# EasyEDA Pro project Zero_PCB_JLCEDA.eprj, schematic Zero_PCB (continued)
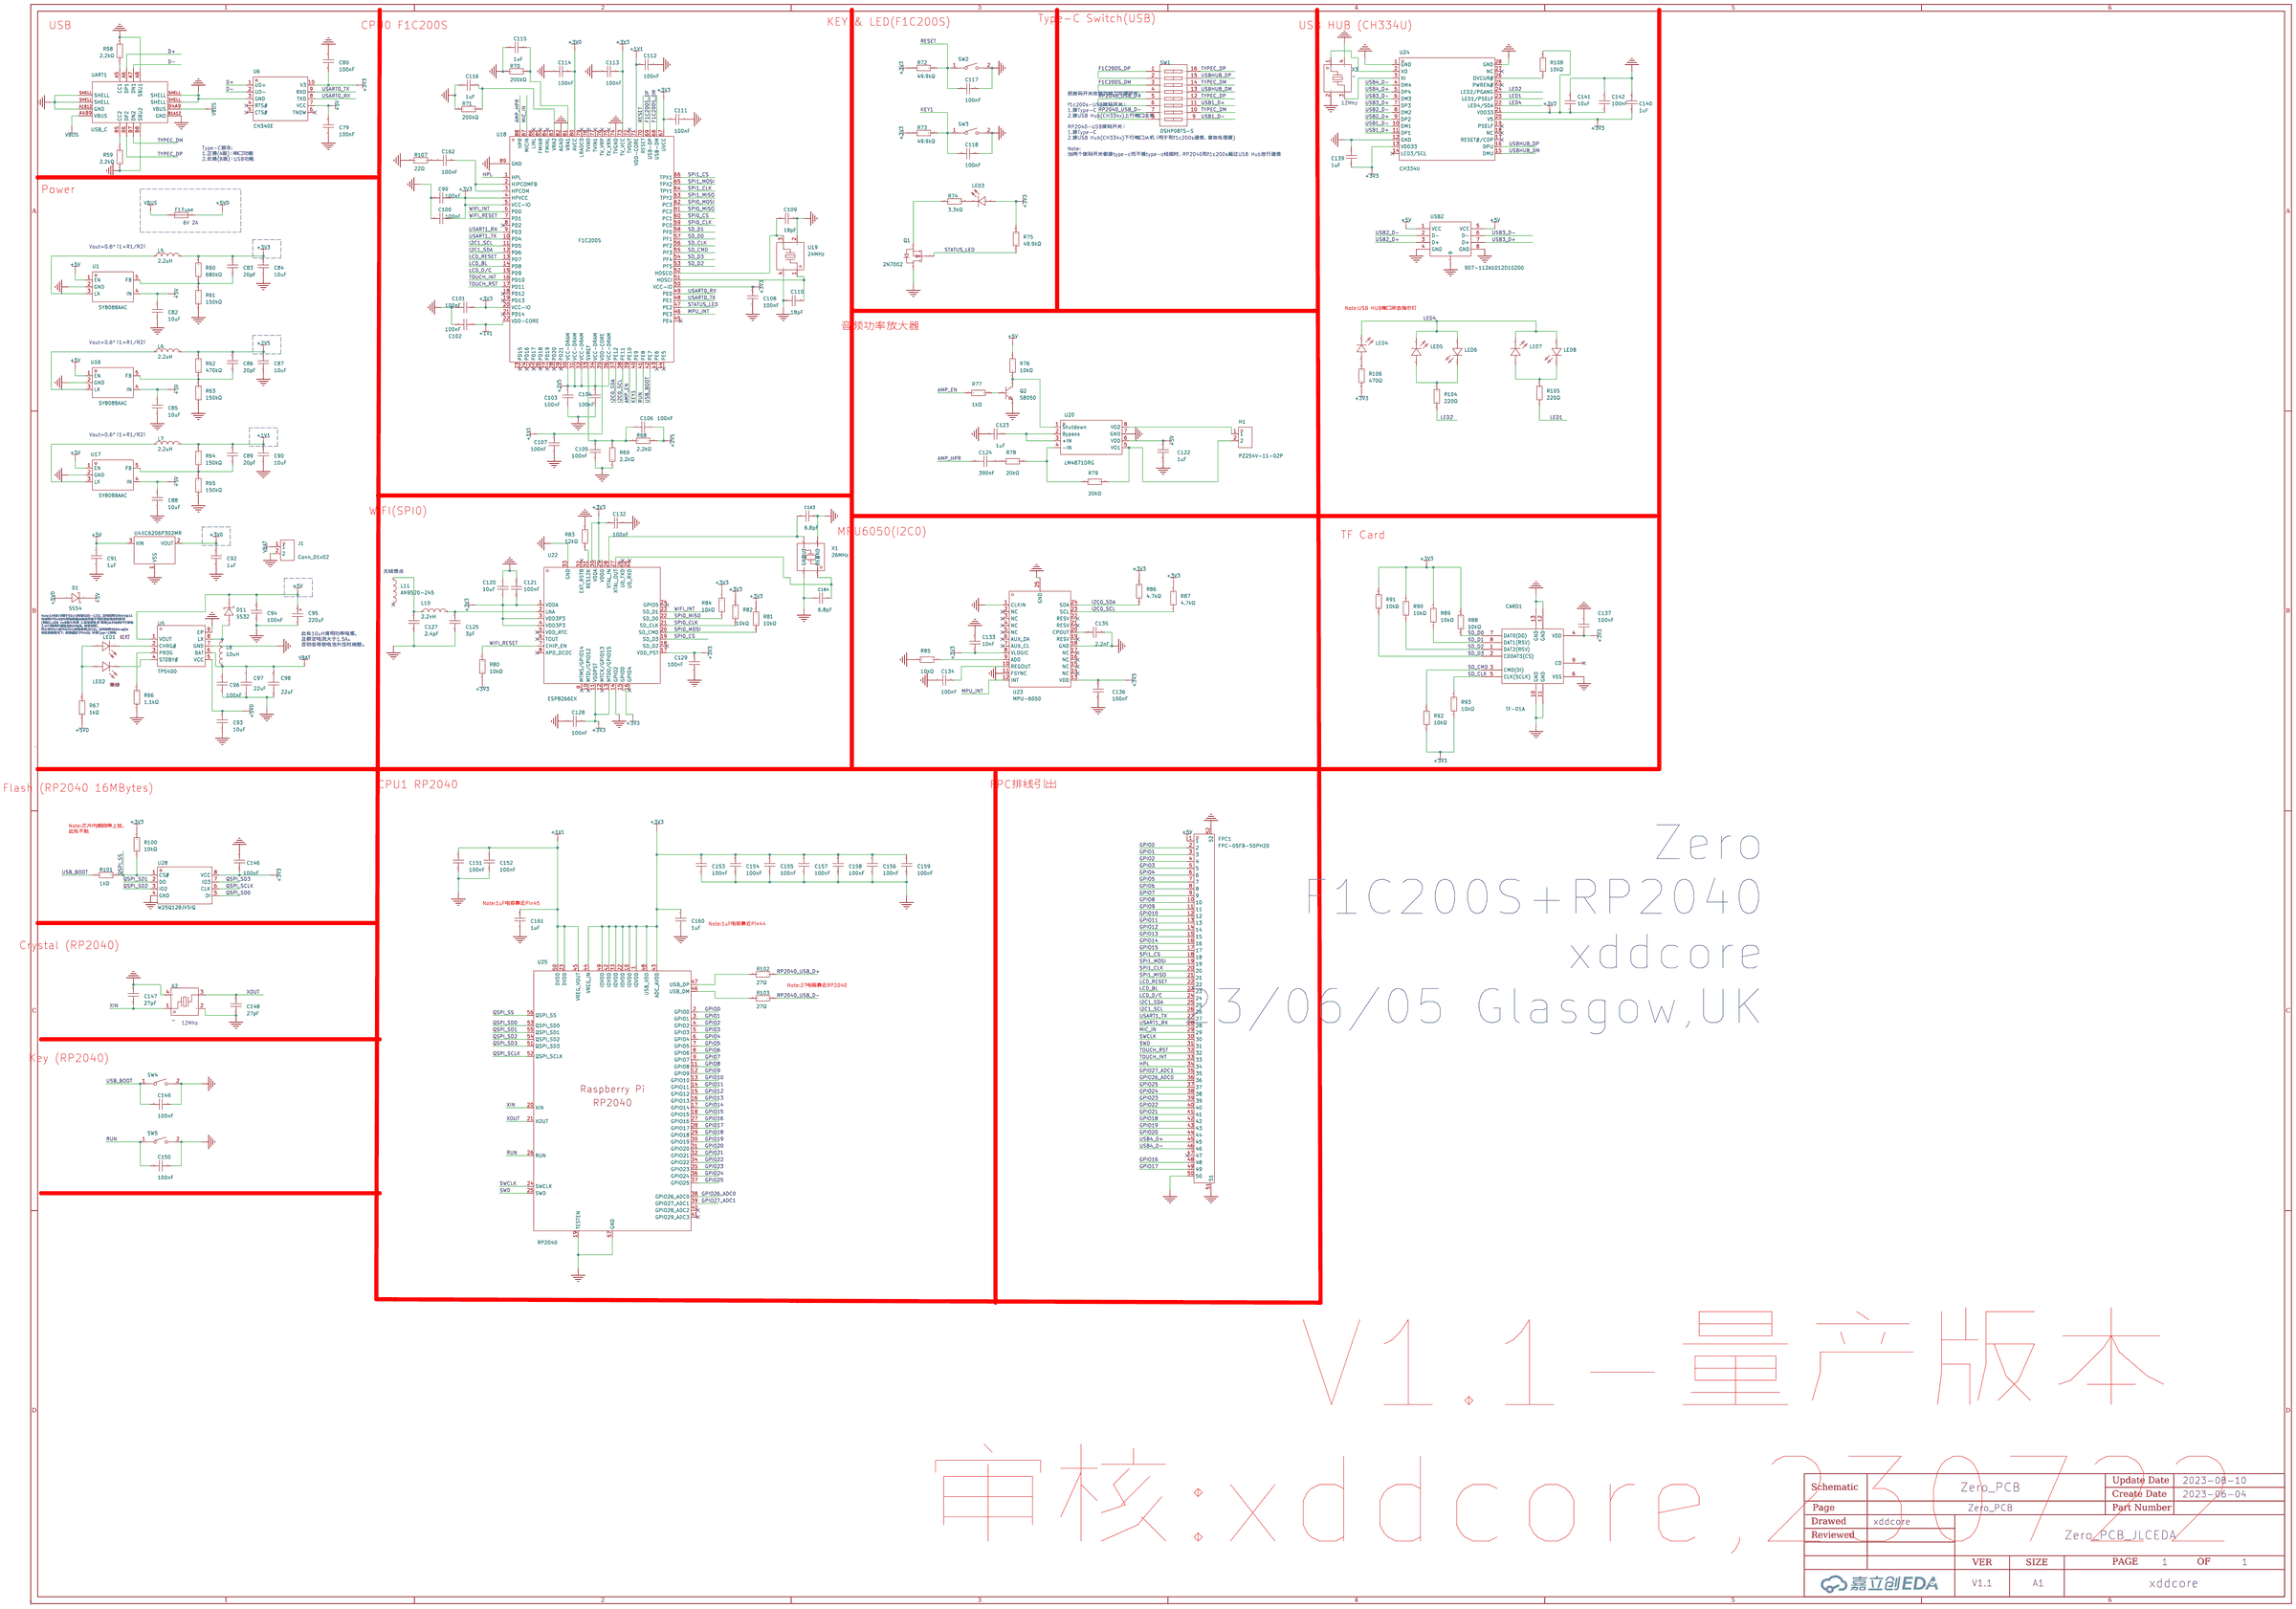
[diagram p0: schematic sheet]
## Library data of the parts (continued)
R60 = RC0402FR-07680KL: 电阻类型:厚膜电阻;阻值:680kΩ;精度:±1%;功率:62.5mW;; LCSC Part Name: 680kΩ ±1% 62.5mW; Supplier Part: C163456; Manufacturer: YAGEO(国巨); Supplier Footprint: 0402; JLCPCB Part Class: Extended Part; Datasheet: https://atta.szlcsc.com/upload/public/pdf/source/20180111/C163456_15156544485521258977.pdf; Supplier: LCSC; Type: 厚膜电阻; Tolerance: ±1%; Power(Watts): 62.5mW; Temperature Coefficient: ±100ppm/℃; Overload Voltage (Max): 50V; Operating Temperature Range: -55℃~+155℃
R61 R63-R65 = 0402WGF1503TCE: 电阻类型:厚膜电阻;阻值:150kΩ;精度:±1%;功率:62.5mW;; LCSC Part Name: 150kΩ ±1% 62.5mW; Supplier Part: C25755; Manufacturer: UNI-ROYAL(厚声); Supplier Footprint: 0402; JLCPCB Part Class: Basic Part; Datasheet: https://atta.szlcsc.com/upload/public/pdf/source/20200306/C422600_1E6D84923E4A46A82E41ADD87F860B5C.pdf; Supplier: LCSC; Type: 厚膜电阻; Tolerance: ±1%; Power(Watts): 62.5mW; Temperature Coefficient: ±100ppm/℃; Overload Voltage (Max): 50V; Operating Temperature Range: -55℃~+155℃
R62 = 0402WGF4703TCE: 电阻类型:厚膜电阻;阻值:470kΩ;精度:±1%;功率:62.5mW;; LCSC Part Name: 470kΩ ±1% 62.5mW; Supplier Part: C25790; Manufacturer: UNI-ROYAL(厚声); Supplier Footprint: 0402; JLCPCB Part Class: Basic Part; Datasheet: https://atta.szlcsc.com/upload/public/pdf/source/20200306/C422600_1E6D84923E4A46A82E41ADD87F860B5C.pdf; Supplier: LCSC; Type: 厚膜电阻; Tolerance: ±1%; Power(Watts): 62.5mW; Temperature Coefficient: ±100ppm/℃; Overload Voltage (Max): 50V; Operating Temperature Range: -55℃~+155℃
R66 = 0402WGF1101TCE: 电阻类型:厚膜电阻;阻值:1.1kΩ;精度:±1%;功率:62.5mW;; LCSC Part Name: 1.1kΩ ±1% 62.5mW; Supplier Part: C25860; Manufacturer: UNI-ROYAL(厚声); Supplier Footprint: 0402; JLCPCB Part Class: Extended Part; Datasheet: https://atta.szlcsc.com/upload/public/pdf/source/20200306/C422600_1E6D84923E4A46A82E41ADD87F860B5C.pdf; Supplier: LCSC; Type: 厚膜电阻; Tolerance: ±1%; Power(Watts): 62.5mW; Temperature Coefficient: ±100ppm/℃; Overload Voltage (Max): 50V; Operating Temperature Range: -55℃~+155℃
R67 R77 R101 = 0402WGJ0102TCE: 电阻类型:厚膜电阻;阻值:1kΩ;精度:±5%;功率:62.5mW;; LCSC Part Name: 1kΩ ±5% 62.5mW; Supplier Part: C25543; Manufacturer: UNI-ROYAL(厚声); Supplier Footprint: 0402; JLCPCB Part Class: Extended Part; Datasheet: https://atta.szlcsc.com/upload/public/pdf/source/20200306/C422600_1E6D84923E4A46A82E41ADD87F860B5C.pdf; Supplier: LCSC; Type: 厚膜电阻; Tolerance: ±5%; Power(Watts): 62.5mW; Temperature Coefficient: ±100ppm/℃; Overload Voltage (Max): 50V; Operating Temperature Range: -55℃~+155℃
R70 R71 = 0402WGF2003TCE: 电阻类型:厚膜电阻;阻值:200kΩ;精度:±1%;功率:62.5mW;; LCSC Part Name: 200kΩ ±1% 62.5mW; Supplier Part: C25764; Manufacturer: UNI-ROYAL(厚声); Supplier Footprint: 0402; JLCPCB Part Class: Basic Part; Datasheet: https://atta.szlcsc.com/upload/public/pdf/source/20200306/C422600_1E6D84923E4A46A82E41ADD87F860B5C.pdf; Supplier: LCSC; Type: 厚膜电阻; Tolerance: ±1%; Power(Watts): 62.5mW; Temperature Coefficient: ±100ppm/℃; Overload Voltage (Max): 50V; Operating Temperature Range: -55℃~+155℃
R72 R73 R75 = 0402WGF4992TCE: 电阻类型:厚膜电阻;阻值:49.9kΩ;精度:±1%;功率:62.5mW;; LCSC Part Name: 49.9kΩ ±1% 62.5mW; Supplier Part: C25897; Manufacturer: UNI-ROYAL(厚声); Supplier Footprint: 0402; JLCPCB Part Class: Basic Part; Datasheet: https://atta.szlcsc.com/upload/public/pdf/source/20200306/C422600_1E6D84923E4A46A82E41ADD87F860B5C.pdf; Supplier: LCSC; Type: 厚膜电阻; Tolerance: ±1%; Power(Watts): 62.5mW; Temperature Coefficient: ±100ppm/℃; Overload Voltage (Max): 50V; Operating Temperature Range: -55℃~+155℃
R74 = 0402WGF3301TCE: 电阻类型:厚膜电阻;阻值:3.3kΩ;精度:±1%;功率:62.5mW;; LCSC Part Name: 3.3kΩ ±1% 62.5mW; Supplier Part: C25890; Manufacturer: UNI-ROYAL(厚声); Supplier Footprint: 0402; JLCPCB Part Class: Basic Part; Datasheet: https://atta.szlcsc.com/upload/public/pdf/source/20200306/C422600_1E6D84923E4A46A82E41ADD87F860B5C.pdf; Supplier: LCSC; Type: 厚膜电阻; Tolerance: ±1%; Power(Watts): 62.5mW; Temperature Coefficient: ±100ppm/℃; Overload Voltage (Max): 50V; Operating Temperature Range: -55℃~+155℃
R76 R80-R82 R84 R85 R88-R93 R100 R108 = 0402WGF1002TCE: 电阻类型:厚膜电阻;阻值:10kΩ;精度:±1%;功率:62.5mW;; LCSC Part Name: 10kΩ ±1% 62.5mW; Supplier Part: C25744; Manufacturer: UNI-ROYAL(厚声); Supplier Footprint: 0402; JLCPCB Part Class: Basic Part; Datasheet: https://atta.szlcsc.com/upload/public/pdf/source/20200306/C422600_1E6D84923E4A46A82E41ADD87F860B5C.pdf; Supplier: LCSC; Type: 厚膜电阻; Tolerance: ±1%; Power(Watts): 62.5mW; Temperature Coefficient: ±100ppm/℃; Overload Voltage (Max): 50V; Operating Temperature Range: -55℃~+155℃
R78 R79 = 0402WGF2002TCE: 电阻类型:厚膜电阻;阻值:20kΩ;精度:±1%;功率:62.5mW;; LCSC Part Name: 20kΩ ±1% 62.5mW; Supplier Part: C25765; Manufacturer: UNI-ROYAL(厚声); Supplier Footprint: 0402; JLCPCB Part Class: Basic Part; Datasheet: https://atta.szlcsc.com/upload/public/pdf/source/20200306/C422600_1E6D84923E4A46A82E41ADD87F860B5C.pdf; Supplier: LCSC; Type: 厚膜电阻; Tolerance: ±1%; Power(Watts): 62.5mW; Temperature Coefficient: ±100ppm/℃; Overload Voltage (Max): 50V; Operating Temperature Range: -55℃~+155℃
R83 = 0402WGF1202TCE: 电阻类型:厚膜电阻;阻值:12kΩ;精度:±1%;功率:62.5mW;; LCSC Part Name: 12kΩ ±1% 62.5mW; Supplier Part: C25752; Manufacturer: UNI-ROYAL(厚声); Supplier Footprint: 0402; JLCPCB Part Class: Basic Part; Datasheet: https://atta.szlcsc.com/upload/public/pdf/source/20200306/C422600_1E6D84923E4A46A82E41ADD87F860B5C.pdf; Supplier: LCSC; Type: 厚膜电阻; Tolerance: ±1%; Power(Watts): 62.5mW; Temperature Coefficient: ±100ppm/℃; Overload Voltage (Max): 50V; Operating Temperature Range: -55℃~+155℃
R86 R87 = 0402WGF4701TCE: 电阻类型:厚膜电阻;阻值:4.7kΩ;精度:±1%;功率:62.5mW;; LCSC Part Name: 4.7kΩ ±1% 62.5mW; Supplier Part: C25900; Manufacturer: UNI-ROYAL(厚声); Supplier Footprint: 0402; JLCPCB Part Class: Basic Part; Datasheet: https://atta.szlcsc.com/upload/public/pdf/source/20200306/C422600_1E6D84923E4A46A82E41ADD87F860B5C.pdf; Supplier: LCSC; Type: 厚膜电阻; Tolerance: ±1%; Power(Watts): 62.5mW; Temperature Coefficient: ±100ppm/℃; Overload Voltage (Max): 50V; Operating Temperature Range: -55℃~+155℃
R102 R103 = 0402WGJ0270TCE: 电阻类型:厚膜电阻;阻值:27Ω;精度:±5%;功率:62.5mW;; LCSC Part Name: 27Ω ±5% 62.5mW; Supplier Part: C25156; Manufacturer: UNI-ROYAL(厚声); Supplier Footprint: 0402; JLCPCB Part Class: Extended Part; Datasheet: https://atta.szlcsc.com/upload/public/pdf/source/20200306/C422600_1E6D84923E4A46A82E41ADD87F860B5C.pdf; Supplier: LCSC; Type: 厚膜电阻; Tolerance: ±5%; Power(Watts): 62.5mW; Temperature Coefficient: ±100ppm/℃; Overload Voltage (Max): 50V; Operating Temperature Range: -55℃~+155℃
R104 R105 = 0402WGF2200TCE: 电阻类型:厚膜电阻;阻值:220Ω;精度:±1%;功率:62.5mW;; LCSC Part Name: 220Ω ±1% 62.5mW; Supplier Part: C25091; Manufacturer: UNI-ROYAL(厚声); Supplier Footprint: 0402; JLCPCB Part Class: Basic Part; Datasheet: https://atta.szlcsc.com/upload/public/pdf/source/20200306/C422600_1E6D84923E4A46A82E41ADD87F860B5C.pdf; Supplier: LCSC; Type: 厚膜电阻; Tolerance: ±1%; Power(Watts): 62.5mW; Temperature Coefficient: ±100ppm/℃; Overload Voltage (Max): 50V; Operating Temperature Range: -55℃~+155℃
R106 = 0402WGF4700TCE: 电阻类型:厚膜电阻;阻值:470Ω;精度:±1%;功率:62.5mW;; LCSC Part Name: 470Ω ±1% 62.5mW; Supplier Part: C25117; Manufacturer: UNI-ROYAL(厚声); Supplier Footprint: 0402; JLCPCB Part Class: Basic Part; Datasheet: https://atta.szlcsc.com/upload/public/pdf/source/20200306/C422600_1E6D84923E4A46A82E41ADD87F860B5C.pdf; Supplier: LCSC; Type: 厚膜电阻; Tolerance: ±1%; Power(Watts): 62.5mW; Temperature Coefficient: ±100ppm/℃; Overload Voltage (Max): 50V; Operating Temperature Range: -55℃~+155℃
R107 = 0402WGF220JTCE: 电阻类型:厚膜电阻;阻值:22Ω;精度:±1%;功率:62.5mW;; LCSC Part Name: 22Ω ±1% 62.5mW; Supplier Part: C25092; Manufacturer: UNI-ROYAL(厚声); Supplier Footprint: 0402; JLCPCB Part Class: Basic Part; Datasheet: https://atta.szlcsc.com/upload/public/pdf/source/20200306/C422600_1E6D84923E4A46A82E41ADD87F860B5C.pdf; Supplier: LCSC; Type: 厚膜电阻; Tolerance: ±1%; Power(Watts): 62.5mW; Temperature Coefficient: ±200ppm/℃; Overload Voltage (Max): 50V; Operating Temperature Range: -55℃~+155℃
SW1 = DSHP08TS-S: 类型:平拨，凹槽式;额定电流:25mA;额定电压:24V;电路结构:单刀单掷;开关位数:8;使用寿命:3千次;颜色:黑色;; LCSC Part Name: 间距1.27mm 平拨,凹槽式 8位拨码开关; Supplier Part: C319047; Manufacturer: XKB Connectivity(中国星坤); Supplier Footprint: SMD-16P,5.4x11.8mm; JLCPCB Part Class: Extended Part; Datasheet: https://atta.szlcsc.com/upload/public/pdf/source/20211009/11BE85C99D2C85B0991AF4F9D6EB8BDE.pdf; Supplier: LCSC; Type: 平拨，凹槽式; Current Rating: 25mA; Voltage Rating: 24V; Circuit: 单刀单掷; Number of Positions: 8; Pin Style: 鸥翼型; Lead Pitch: 1.27mm; Operating Temperature: -20℃~+70℃; Operating Life: 3千次; Color: 黑色
SW2-SW5 = TS-1088-AR02016: 触点电流:50mA;额定电压(DC):12V;绝缘电阻:100MΩ;电路结构:单刀单掷;安装方式:立贴;作用力:160gf@±50gf;机械寿命:10万次;带支架:否;; LCSC Part Name: 4*3*2mm 立贴 轻触开关; Supplier Part: C720477; Manufacturer: XUNPU(讯普); Supplier Footprint: SMD; JLCPCB Part Class: Extended Part; Datasheet: https://atta.szlcsc.com/upload/public/pdf/source/20200810/C720475_60D09DD6C54279ADDB2DC25100F1CC11.pdf; Supplier: LCSC; Contact Current: 50mA; Voltage Rating (DC): 12V; Insulation Resistance: 100MΩ; Circuit: 单刀单掷; Mounting Style: 立贴; Actuator Style: 圆形按钮; Actuator/Cap Color: 黑色; Operating Force: 160gf@±50gf; Mechanical Life: 10万次; Operating Temperature: -30℃~+80℃; Pin Style: SMD接片; Switch Length: 4mm; Switch Width: 3mm; Switch Height: 2mm; Strike Gundam: 否
U1 U16 U17 = SY8088AAC: 功能类型:降压型;同步整流:-;输出通道数:-;拓扑结构:-;输入电压:-;输出电流(最大值):-;开关频率:-;; LCSC Part Name: 降压型; Supplier Part: C79313; Manufacturer: silergy(矽力杰); Supplier Footprint: SOT-23-5; JLCPCB Part Class: Extended Part; Datasheet: https://atta.szlcsc.com/upload/public/pdf/source/20170329/1490752163260.pdf; Supplier: LCSC; Function: 降压型; User doc link: https://item.szlcsc.com/80451.html
U4 = XC6206P302MR_C5148691: 输出类型:固定;输出极性:正;最大输入电压:8V;输出电压:3V;输出电流:300mA;; LCSC Part Name: 输入8V 输出3V 300mA; Supplier Part: C5148691; Manufacturer: HXY MOSFET(华轩阳电子); Supplier Footprint: SOT-23; JLCPCB Part Class: Extended Part; Datasheet: https://atta.szlcsc.com/upload/public/pdf/source/20230315/93E69A1F17D2140E7E20D3C8672F05EE.pdf; Supplier: LCSC; Output Type: 固定; Output Polarity: 正; Number of Outputs: 1; Maximum Input Voltage: 8V; Output Voltage: 3V; Dropout Voltage: 240mV@(50mA); Output Current: 300mA; User doc link: https://www.torexsemi.com/file/xc6206/XC6206.pdf
U5 = TP5400: Supplier Part: C2891434; Manufacturer: TOPPOWER(南京拓微); Supplier Footprint: ESOP-8; JLCPCB Part Class: Extended Part; Datasheet: https://atta.szlcsc.com/upload/public/pdf/source/20210909/352D9D40D77A1DD73F7904E364EF004B.pdf; Supplier: LCSC; User doc link: https://item.szlcsc.com/24894.html
U6 = CH340E: 应用功能:收发器;接口协议:USB 2.0;数据速率:2Mbps;; LCSC Part Name: USB转串口芯片 CH340; Supplier Part: C99652; Manufacturer: WCH(南京沁恒); Supplier Footprint: MSOP-10; JLCPCB Part Class: Extended Part; Datasheet: https://atta.szlcsc.com/upload/public/pdf/source/20200819/C99652_97FFC0DF2539BFF05CD752AD9221D632.pdf; Supplier: LCSC; Applications Function: 收发器; Protocol: USB 2.0; Data Rate: 2Mbps; Supply Voltage: 3.3V；5V; User doc link: https://www.mpja.com/download/35227cpdata.pdf
U18 = F1C200S: CPU内核:-;CPU最大主频:-;程序存储容量:-;程序存储器类型:-;RAM总容量:-;GPIO端口数量:-;ADC(位数):-;工作温度范围:-;; LCSC Part Name: Allwinner F1C200S Allwinner F1C200S; Supplier Part: C2879851; Manufacturer: Allwinner(全志); Supplier Footprint: QFN-88-EP(10x10); JLCPCB Part Class: Extended Part; Datasheet: https://atta.szlcsc.com/upload/public/pdf/source/20211016/C2879851_80200E64F493B5C5B5C583D1EECFE2F1.pdf; Supplier: LCSC
U19 = XXHCCLNANF-24MHZ: 频率:24MHz;频率公差:±20ppm;负载电容:20pF;; Supplier Part: C5160135; Manufacturer: TAITIEN(泰艺电子); Supplier Footprint: SMD3225-4P; JLCPCB Part Class: Extended Part; Datasheet: https://atta.szlcsc.com/upload/public/pdf/source/20221011/C6169EE059BEE5ABCF35F509F47C6D34.pdf; Supplier: LCSC; Crystal Type: 贴片无源晶振; Frequency Tolerance: ±20ppm; Frequency Stability: ±20ppm; Load Capacitance: 20pF; Operating Temperature: -40℃~+85℃
U20 = LM4871DRG: LCSC Part Name: 3W 单声道 AB 类音频功率放大器; Supplier Part: C2977084; Manufacturer: HGC(深圳汉芯); Supplier Footprint: SOP-8; JLCPCB Part Class: Extended Part; Datasheet: https://atta.szlcsc.com/upload/public/pdf/source/20220308/B7DC1C3731235201084084BFF2780ABF.pdf; Supplier: LCSC
U22 = ESP8266EX: 接口:UART;; Supplier Part: C77967; Manufacturer: ESPRESSIF(乐鑫); Supplier Footprint: QFN-32-EP(5x5); JLCPCB Part Class: Extended Part; Datasheet: https://atta.szlcsc.com/upload/public/pdf/source/20170925/C77967_1506321736821990542.pdf; Supplier: LCSC; Interface: UART
U23 = MPU-6050: 三轴加速度计和三轴陀螺仪，工作电压：2.375V~3.46V; Supplier Part: C24112; Manufacturer: TDK InvenSense(应美盛); Supplier Footprint: QFN-24(4x4); JLCPCB Part Class: Basic Part; Datasheet: https://atta.szlcsc.com/upload/public/pdf/source/20140425/1457707046159.pdf; Supplier: LCSC
U24 = CH334U: LCSC Part Name: 芯片; Supplier Part: C5187524; Manufacturer: WCH(南京沁恒); Supplier Footprint: QSOP28; JLCPCB Part Class: Extended Part; Datasheet: https://atta.szlcsc.comnull; Supplier: LCSC
U25 = RP2040_C2040: CPU内核:ARM Cortex-M0;CPU最大主频:133MHz;工作电压范围:-;内部振荡器:-;外部时钟频率范围:-;程序 FLASH容量:-;RAM总容量:264KB;EEPROM/数据 FLASH容量:-;GPIO端口数量:30;ADC(单元数/通道数/位数):1@x4ch/12bit;DAC(单元数/通道数/位数):-;(E)PWM(单元数/通道数/位数):-;8位Timer数量:-;16位Timer数量:-;32位Timer数量:-;内部比较器数量:-;U(S)ART路数:2;I2C路数:; LCSC Part Name: ARM Cortex-M0 133MHz RAM：264KB; Supplier Part: C2040; Manufacturer: Raspberry Pi(树莓派); Supplier Footprint: QFN-56(7x7); JLCPCB Part Class: Extended Part; Datasheet: https://atta.szlcsc.com/upload/public/pdf/source/20210621/C2040_96F425825606B7957D87DD32E2512CA9.pdf; Supplier: LCSC; CPU Core: ARM Cortex-M0; Maximum Frequency: 133MHz; RAM Size: 264KB; GPIO Ports Number: 30; ADC (Units/Channels/bits): 1@x4ch/12bit; U(S)ART Number: 2; I2C Number: 2; (Q)SPI Number: 2; USB (H/D/OTG): USB Host/Device; Peripherals / Functions / Protocol Stacks: DMA；PWM
U28 = W25Q128JVSIQ: 128Mbit(16MBx8bit),高速版,133MHz(266/532MHz Dual/Quad-SPI,66MB/S),比W25Q128FVSIG,W25Q128FVFIG更高速; Supplier Part: C97521; Manufacturer: WINBOND(华邦); Supplier Footprint: SOIC-8-208mil; JLCPCB Part Class: Basic Part; Datasheet: https://atta.szlcsc.com/upload/public/pdf/source/20170316/1489627409956.pdf; Supplier: LCSC
UART1 = U262-161N-4BVC11: 连接器类型:Type-C;标准:USB 3.1;公母:母座;触点数量:16;端口数量:1;安装方式:卧贴;额定电流 - 电源:3A;触头材质:铜合金;触头镀层:金;工作温度范围:-40℃~+85℃;焊接温度(最大值):260℃;; LCSC Part Name: Type-C 母座 卧贴; Supplier Part: C319148; Manufacturer: XKB Connectivity(中国星坤); Supplier Footprint: SMD; JLCPCB Part Class: Extended Part; Datasheet: https://atta.szlcsc.com/upload/public/pdf/source/20211015/B478CBA0F1623DA36A6CC6918C49C838.pdf; Supplier: LCSC; Connector Type: Type-C; Standard: USB 3.1; Gender: 母座; Number of Contacts: 16; Number of Ports: 1; Mounting Style: 卧贴; Current Rating - Power (Max): 3A; Contact Material: 铜合金; Contact Plating: 金; Operating Temperature Range: -40℃~+85℃; Welding Temperature (Max): 260℃; User doc link: https://item.szlcsc.com/372551.html
USB2 = 907-112A1012D10200: 连接器类型:Type-A;标准:USB 2.0;公母:母座;触点数量:4+4;端口数量:2;安装方式:弯插;额定电流 - 电源:-;工作温度范围:-;; LCSC Part Name: Type-A 母座 弯插 双层半包弯脚有边平弹铜壳PBT白胶; Supplier Part: C39469; Manufacturer: 精拓金; Supplier Footprint: 插件; JLCPCB Part Class: Extended Part; Datasheet: https://atta.szlcsc.com/upload/public/pdf/source/20210226/C39469_909706351C6DC70CABD29826FA54CA56.pdf; Supplier: LCSC; Connector Type: Type-A; Standard: USB 2.0; Gender: 母座; Number of Contacts: 4+4; Number of Ports: 2; Mounting Style: 弯插
X1 = NX3225SA-26MHZ-STD-CQR-1: 频率:26MHz;频率公差:±10ppm;负载电容:8pF;; LCSC Part Name: 26MHz ±10ppm 8pF; Supplier Part: C156251; Manufacturer: NDK; Supplier Footprint: SMD3225-4P; JLCPCB Part Class: Extended Part; Datasheet: https://atta.szlcsc.com/upload/public/pdf/source/20171201/C156251_15121213461871157579.pdf; Supplier: LCSC; Crystal Type: 贴片无源晶振; Frequency Tolerance: ±10ppm; Load Capacitance: 8pF; Equivalent Series Resistance (ESR): 50Ω; Operating Temperature: -20℃~+75℃
X2 X3 = XYDBPCNANF-12MHZ: 频率:-;负载电容:-;; LCSC Part Name: 12MHz 12pF ±10ppm -20~+70℃; Supplier Part: C521567; Manufacturer: TAITIEN(泰艺电子); Supplier Footprint: SMD2520-4P; JLCPCB Part Class: Extended Part; Datasheet: https://atta.szlcsc.com/upload/public/pdf/source/20200427/C521567_8D8DDB0F2E066B5BAD7A5878EBE465E2.pdf; Supplier: LCSC

## Nets
+1V1: C89.2 C90.2 C102.1 C107.2 C112.2 C151.1 C152.1 C161.2 L7.2 R64.2 U18.22(VDD-CORE) U18.35(VDD-CORE) U18.71(VDD-CORE) U25.23(DVDD) U25.45(VREG_VOUT) U25.50(DVDD)
+2V5: C86.2 C87.2 C103.2 C104.2 C106.1 L6.2 R62.2 R68.1 U18.30(VCC-DRAM) U18.31(VCC-DRAM) U18.32(VCC-DRAM) U18.34(VCC-DRAM) U18.36(VCC-DRAM)
+3V0: C92.1 C114.2 U4.2(VOUT) U18.80(AVCC)
+3V3: C80.1 C83.2 C84.2 C99.2 C100.2 C101.1 C108.2 C111.2 C113.2 C120.1 C121.1 C128.2 C129.2 C132.1 C133.1 C136.2 C137.1 C139.2 C140.1 C141.1 C142.1 C146.1 C153.1 C154.1 C155.1 C156.1 C157.1 C158.1 C159.1 C160.2 CARD1.4(VDD) L5.2 LED3.1(A) R60.2 R72.1 R73.1 R75.2 R80.1 R81.1 R82.1 R84.1 R86.2 R87.2 R88.2 R89.2 R90.2 R91.2 R92.1 R93.1 R100.2 R106.2 R108.2 U6.10(V3) U18.4(HPVCC) U18.5(VCC-IO) U18.20(VCC-IO) U18.50(VCC-IO) U18.67(UVCC) U18.73(TV_VCC) U22.1(VDDA) U22.3(VDD3P3) U22.4(VDD3P3) U22.11(VDDPST) U22.13(MTDO/GPIO15) U22.15(GPIO0) U22.17(VDD_PST) U22.29(VDDD) U22.30(VDDA) U23.8(VLOGIC) U23.13(VDD) U24.13(VDD33) U24.20(V5) U24.21(VDD33) U25.1(IOVDD) U25.10(IOVDD) U25.22(IOVDD) U25.33(IOVDD) U25.42(IOVDD) U25.43(ADC_AVDD) U25.44(VREG_IN) U25.48(USB_VDD) U25.49(IOVDD) U28.8(VCC)
+5V: C79.2 C82.2 C85.2 C88.2 C91.1 C94.2 C95.1 C122.2 D1.2(K) D11.1(K) FPC1.1 R76.2 U1.1(EN) U1.4(IN) U4.3(VIN) U5.1(VOUT) U6.7(VCC) U16.1(EN) U16.4(IN) U17.1(EN) U17.4(IN) U20.6(VDD) USB2.1(VCC) USB2.5(VCC)
+5VD: C93.2 D1.1(A) F1.1 R67.1 U5.5(VCC)
GND: C79.1 C80.2 C82.1 C84.1 C85.1 C87.1 C88.1 C90.1 C91.2 C92.2 C93.1 C94.1 C95.2 C96.1 C97.1 C98.1 C99.1 C100.1 C101.2 C102.2 C103.1 C104.1 C105.1 C107.1 C108.1 C109.1 C110.2 C111.1 C112.1 C113.1 C114.1 C115.1 C116.1 C117.2 C118.2 C120.2 C121.2 C122.1 C123.1 C125.1 C127.1 C128.1 C129.1 C132.2 C133.2 C134.1 C135.2 C136.1 C137.2 C139.1 C140.2 C141.2 C142.2 C146.2 C147.2 C148.1 C149.1 C150.1 C151.2 C152.2 C153.2 C154.2 C155.2 C156.2 C157.2 C158.2 C159.2 C160.1 C161.1 C163.2 C164.1 CARD1.6(VSS) CARD1.10(GND) CARD1.11(GND) CARD1.12(GND) CARD1.13(GND) FPC1.50 FPC1.51 FPC1.52 J1.2 Q1.3(D) Q2.2 R58.2 R59.1 R61.1 R63.1 R65.1 R66.1 R69.2 R70.1 R71.1 R83.2 R85.1 R107.1 SW2.2 SW3.2 SW4.2 SW5.2 U1.2(GND) U4.1(VSS) U5.7(GND) U5.9(EP) U6.3(GND) U16.2(GND) U17.2(GND) U18.74(TVGND) U18.82(AGND) U18.89(GND) U19.2(GND) U19.4(GND) U20.7(GND) U22.14(GPIO2) U22.33(GND) U23.1(CLKIN) U23.11(FSYNC) U23.18(GND) U23.25(GND) U24.1(GND) U24.12(GND) U24.28(GND) U25.19(TESTEN) U25.57(GND) U28.4(GND) UART1.A1B12(GND) UART1.A8(SBU1) UART1.B1A12(GND) UART1.B8(SBU2) UART1.SHELL USB2.4(GND) USB2.8(GND) USB2.9 X1.2(GND) X1.4(GND) X2.2(GND) X2.4(GND) X3.2(GND) X3.4(GND)
VBAT: C96.2 C97.2 C98.2 J1.1 L8.1 U5.6(BAT)
VBUS: F1.2 UART1.A4B9(VBUS) UART1.B4A9(VBUS)
AMP_EN: R77.2 U18.39(PE10)
AMP_HPR: C124.1 U18.88(HPR)
D+: U6.1(UD+) UART1.A6(DP1)
D-: U6.2(UD-) UART1.A7(DN1)
F1C200S_DM: SW1.3(A3) SW1.4(A4) U18.68(USB-DM)
F1C200S_DP: SW1.1(A1) SW1.2(A2) U18.69(USB-DP)
GPIO0: FPC1.2 U25.2(GPIO0)
GPIO1: FPC1.3 U25.3(GPIO1)
GPIO2: FPC1.4 U25.4(GPIO2)
GPIO3: FPC1.5 U25.5(GPIO3)
GPIO4: FPC1.6 U25.6(GPIO4)
GPIO5: FPC1.7 U25.7(GPIO5)
GPIO6: FPC1.8 U25.8(GPIO6)
GPIO7: FPC1.9 U25.9(GPIO7)
GPIO8: FPC1.10 U25.11(GPIO8)
GPIO9: FPC1.11 U25.12(GPIO9)
GPIO10: FPC1.12 U25.13(GPIO10)
GPIO11: FPC1.13 U25.14(GPIO11)
GPIO12: FPC1.14 U25.15(GPIO12)
GPIO13: FPC1.15 U25.16(GPIO13)
GPIO14: FPC1.16 U25.17(GPIO14)
GPIO15: FPC1.17 U25.18(GPIO15)
GPIO16: FPC1.48 U25.27(GPIO16)
GPIO17: FPC1.49 U25.28(GPIO17)
GPIO18: FPC1.42 U25.29(GPIO18)
GPIO19: FPC1.43 U25.30(GPIO19)
GPIO20: FPC1.44 U25.31(GPIO20)
GPIO21: FPC1.41 U25.32(GPIO21)
GPIO22: FPC1.40 U25.34(GPIO22)
GPIO23: FPC1.39 U25.35(GPIO23)
GPIO24: FPC1.38 U25.36(GPIO24)
GPIO25: FPC1.37 U25.37(GPIO25)
GPIO26_ADC0: FPC1.36 U25.38(GPIO26_ADC0)
GPIO27_ADC1: FPC1.35 U25.39(GPIO27_ADC1)
HPL: FPC1.34 U18.1(HPL)
I2C0_SCL: R87.1 U18.38(PE11) U23.23(SCL)
I2C0_SDA: R86.1 U18.37(PE12) U23.24(SDA)
I2C1_SCL: FPC1.26 U18.11(PD5)
I2C1_SDA: FPC1.25 U18.12(PD6)
KEY1: C118.1 R73.2 SW3.1 U18.40(PE9)
LCD_BL: FPC1.23 U18.14(PD8)
LCD_D/C: FPC1.24 U18.15(PD9)
LCD_RESET: FPC1.22 U18.13(PD7)
LED1: R105.1 U24.23(LED1/PSELF)
LED2: R104.1 U24.24(LED2/PGANG)
LED4: LED4.1(K) LED5.1(K) LED6.2(A) LED7.1(K) LED8.2(A) U24.22(LED4/SDA)
MIC_IN: FPC1.29 U18.87(MICIN)
MPU_INT: U18.46(PE3) U23.12(INT)
QSPI_SCLK: U25.52(QSPI_SCLK) U28.6(CLK)
QSPI_SD0: U25.53(QSPI_SD0) U28.5(DI)
QSPI_SD1: U25.55(QSPI_SD1) U28.2(DO)
QSPI_SD2: U25.54(QSPI_SD2) U28.3(IO2)
QSPI_SD3: U25.51(QSPI_SD3) U28.7(IO3)
QSPI_SS: R100.1 R101.2 U25.56(QSPI_SS) U28.1(CS#)
RESET: C117.1 R72.2 SW2.1 U18.70(RESET)
RP2040_USB_D+: R102.2 SW1.5(A5) SW1.6(A6)
RP2040_USB_D-: R103.2 SW1.7(A7) SW1.8(A8)
RUN: C150.2 SW5.1 U18.41(PE8) U25.26(RUN)
SD_CLK: CARD1.5(CLK(SCLK)) R93.2 U18.56(PF2)
SD_CMD: CARD1.3(CMD(DI)) R92.2 U18.55(PF3)
SD_D0: CARD1.7(DAT0(D0)) R88.1 U18.57(PF1)
SD_D1: CARD1.8(DAT1(RSV)) R89.1 U18.58(PF0)
SD_D2: CARD1.1(DAT2(RSV)) R90.1 U18.53(PF5)
SD_D3: CARD1.2(CDDAT3(CS)) R91.1 U18.54(PF4)
SPI0_CLK: R82.2 U18.59(PC0) U22.21(SD_CLK)
SPI0_CS: U18.60(PC1) U22.19(SD_D3)
SPI0_MISO: R84.2 U18.61(PC2) U22.22(SD_D0)
SPI0_MOSI: R81.2 U18.62(PC3) U22.20(SD_CMD)
SPI1_CLK: FPC1.20 U18.64(TPY1)
SPI1_CS: FPC1.18 U18.66(TPX1)
SPI1_MISO: FPC1.21 U18.63(TPY2)
SPI1_MOSI: FPC1.19 U18.65(TPX2)
STATUS_LED: Q1.1(G) R75.1 U18.47(PE2)
SWCLK: FPC1.30 U25.24(SWCLK)
SWD: FPC1.31 U25.25(SWD)
TOUCH_INT: FPC1.33 U18.16(PD10)
TOUCH_RST: FPC1.32 U18.17(PD11)
TYPEC_DM: SW1.10(B7) SW1.14(B3) UART1.B7(DN2)
TYPEC_DP: SW1.12(B5) SW1.16(B1) UART1.B6(DP2)
USART0_RX: U6.8(TXD) U18.49(PE0)
USART0_TX: U6.9(RXD) U18.48(PE1)
USART1_RX: FPC1.28 U18.9(PD3)
USART1_TX: FPC1.27 U18.10(PD4)
USB1_D+: SW1.11(B6) U24.11(DP1)
USB1_D-: SW1.9(B8) U24.10(DM1)
USB2_D+: U24.9(DP2) USB2.3(D+)
USB2_D-: U24.8(DM2) USB2.2(D-)
USB3_D+: U24.7(DP3) USB2.7(D+)
USB3_D-: U24.6(DM3) USB2.6(D-)
USB4_D+: FPC1.45 U24.5(DP4)
USB4_D-: FPC1.46 U24.4(DM4)
USB_BOOT: C149.2 R101.1 SW4.1 U18.42(PE7)
USBHUB_DM: SW1.13(B4) U24.15(DMU)
USBHUB_DP: SW1.15(B2) U24.16(DPU)
WIFI_INT: U18.6(PD0) U22.23(SD_D1)
WIFI_RESET: R80.2 U18.7(PD1) U22.7(CHIP_EN)
XIN: C147.1 U25.20(XIN) X2.1
XOUT: C148.2 U25.21(XOUT) X2.3
$1N21711: R58.1 UART1.A5(CC1)
$1N21714: R59.2 UART1.B5(CC2)
$1N27959: L5.1 U1.3(LX)
$1N28302: C83.1 R60.1 R61.2 U1.5(FB)
$1N28688: L6.1 U16.3(LX)
$1N28696: C86.1 R62.1 R63.2 U16.5(FB)
$1N32220: L7.1 U17.3(LX)
$1N32222: C89.1 R64.1 R65.2 U17.5(FB)
$1N51512: LED2.1(K) U5.4(STDBY#)
$1N51517: LED1.1(K) U5.2(CHRG#)
$1N51525: LED1.2(A) LED2.2(A) R67.2
$1N51543: R66.2 U5.3(PROG)
$1N51674: D11.2(A) L8.2 U5.8(LX)
$1N53264: C105.2 C106.2 R68.2 R69.1 U18.33(SVREF)
$1N53710: C110.1 U18.51(HOSCI) U19.1
$1N53734: C109.2 U18.52(HOSCO) U19.3
$1N54438: C115.2 R70.2 U18.81(VRA1)
$1N54475: C116.2 R71.2 U18.83(VRA2)
$1N55245: LED3.2(K) R74.2
$1N55371: Q1.2(S) R74.1
$1N57514: Q2.1 R77.1
$1N57526: Q2.3 R76.1 U20.1(Shutdown)
$1N57748: C123.2 U20.2(Bypass) U20.3(+IN)
$1N57804: C124.2 R78.1
$1N57843: R78.2 R79.1 U20.4(-IN)
$1N57974: H1.2 R79.2 U20.5(VO1)
$1N57983: H1.1 U20.8(VO2)
$1N59147: C125.2 L10.2 U22.2(LNA)
$1N60101: R83.1 U22.31(RES12K)
$1N60445: C163.1 U22.28(XTAL_IN) X1.3(OUT)
$1N60452: C164.2 U22.27(XTAL_OUT) X1.1(OE#)
$1N60619: R85.2 U23.9(AD0)
$1N60746: C134.2 U23.10(REGOUT)
$1N60867: C135.1 U23.20(CPOUT)
$1N62198: U24.2(XO) X3.1
$1N62206: U24.3(XI) X3.3
$1N75896: R108.1 U24.26(OVCUR#)
$1N77675: R102.1 U25.47(USB_DP)
$1N77680: R103.1 U25.46(USB_DM)
$1N78675: LED4.2(A) R106.1
$1N78743: LED7.2(A) LED8.1(K) R105.2
$1N83735: LED5.2(A) LED6.1(K) R104.2
$1N94983: C127.2 L10.1 L11.1
$1N101606: C162.1 R107.2
$1N101653: C162.2 U18.2(HIPCOMFB) U18.3(HPCOM)

Not connected (* = marked no-connect by the designer): CARD1 9(CD)*; FPC1 47*; L11 2*; U6 4(RTS#)* 5(CTS#)* 6(TNOW)*; U18 8(PD2)* 18(PD12)* 19(PD13)* 21(PD14)* 23(PD15)* 24(PD16)* 25(PD17)* 26(PD18)* 27(PD19)* 28(PD20)* 29(PD21)* 43(PE6)* 44(PE5)* 45(PE4)* 72(TVOUT)* 75(TV_VRN)* 76(TV_VRP)* 77(TVIN1)* 78(TVIN0)* 79(LRADC0)* 84(FMINL)* 85(FMINR)* 86(LINL)*; U22 5(VDD_RTC)* 6(TOUT)* 8(XPD_DCDC)* 9(MTMS/GPIO14)* 10(MTDI/GPIO12)* 12(MTCK/GPIO13)* 16(GPIO4)* 18(SD_D2)* 24(GPIO5)* 25(U0_RXD)* 26(U0_TXD)* 32(EXT_RSTB)*; U23 2(NC)* 3(NC)* 4(NC)* 5(NC)* 6(AUX_DA)* 7(AUX_CL)* 14(NC)* 15(NC)* 16(NC)* 17(NC)* 19(RESV)* 21(RESV)* 22(RESV)*; U24 14(LED3/SCL)* 17(RESET#/CDP)* 18(NC)* 19(PSELF)* 25(PWREN#)* 27(NC)*; U25 40(GPIO28_ADC2)* 41(GPIO29_ADC3)*

## Notes on the sheet
- USB
- CPU0 F1C200S
- KEY & LED(F1C200S)
- Type-C Switch(USB)
- USB HUB (CH334U)
- 12Mhz
- Type-C插法:
  1.正插(A面)：串口功能
  2.反插(B面)：USB功能
- 把拨码开关改装为单刀双掷开关。
  f1c200s-USB拨码开关：
  1.接Type-C
  2.接USB Hub(CH334x)上行端口主机
  RP2040-USB拨码开关：
  1.接Type-C
  2.接USB Hub(CH334x)下行端口从机（用于和f1c200s通信，做协处理器)
  Note:
  当两个拨码开关都接type-c而不插type-c线缆时，RP2040和f1c200s越过USB Hub进行通信
- Power
- 6V 2A
- Vout=0.6*（1+R1/R2）
- Note:USB HUB端口状态指示灯
- 音频功率放大器
- Vout=0.6*（1+R1/R2）
- Vout=0.6*（1+R1/R2）
- WIFI(SPI0)
- MPU6050(I2C0)
- TF Card
- 天线馈点
- Note:1N5819属于SS14(封装SOD-123)，正向压降500mV@1A
  考虑到TP5400升压电路输出电流可能不满足设备需求的情况
  (例如1.USB HUB接大负载 2.其他设备(扩展板)从引出的FPC取电
  3.WIFI瞬间开启造成的大电流，导致压降。
  所以将SS14换为SS54(封装兼容2010)，正向压降550mv@5A
  满足某些情况下，直接越过TP5400，外接Type-C供电
- 此处10uH请用功率电感，
  且额定电流大于1.5A。
  否则会导致电池升压时烧毁。
- CPU1 RP2040
- FPC排线引出
- Flash (RP2040 16MBytes)
- Zero
  F1C200S+RP2040
  xddcore
  23/06/05 Glasgow,UK
- Note:芯片内部自带上拉，
  此处不贴
- Note:1uF电容靠近Pin45
- Note:1uF电容靠近Pin44
- Crystal (RP2040)
- Note:27电阻靠近RP2040
- 12Mhz
- Key (RP2040)
- V1.1-量产版本
  审核:xddcore,230722
